# EasyEDA Pro project cubicat_pcb.eprj, schematic Schematic
Create Date: 2024-10-24; Page Name: P1; Project Name: cubicat_CS3; Schematic Name: Schematic1_1; Update Date: 2024-10-24; Company: 嘉立创EDA; Page Size: A4; Version: V1.0
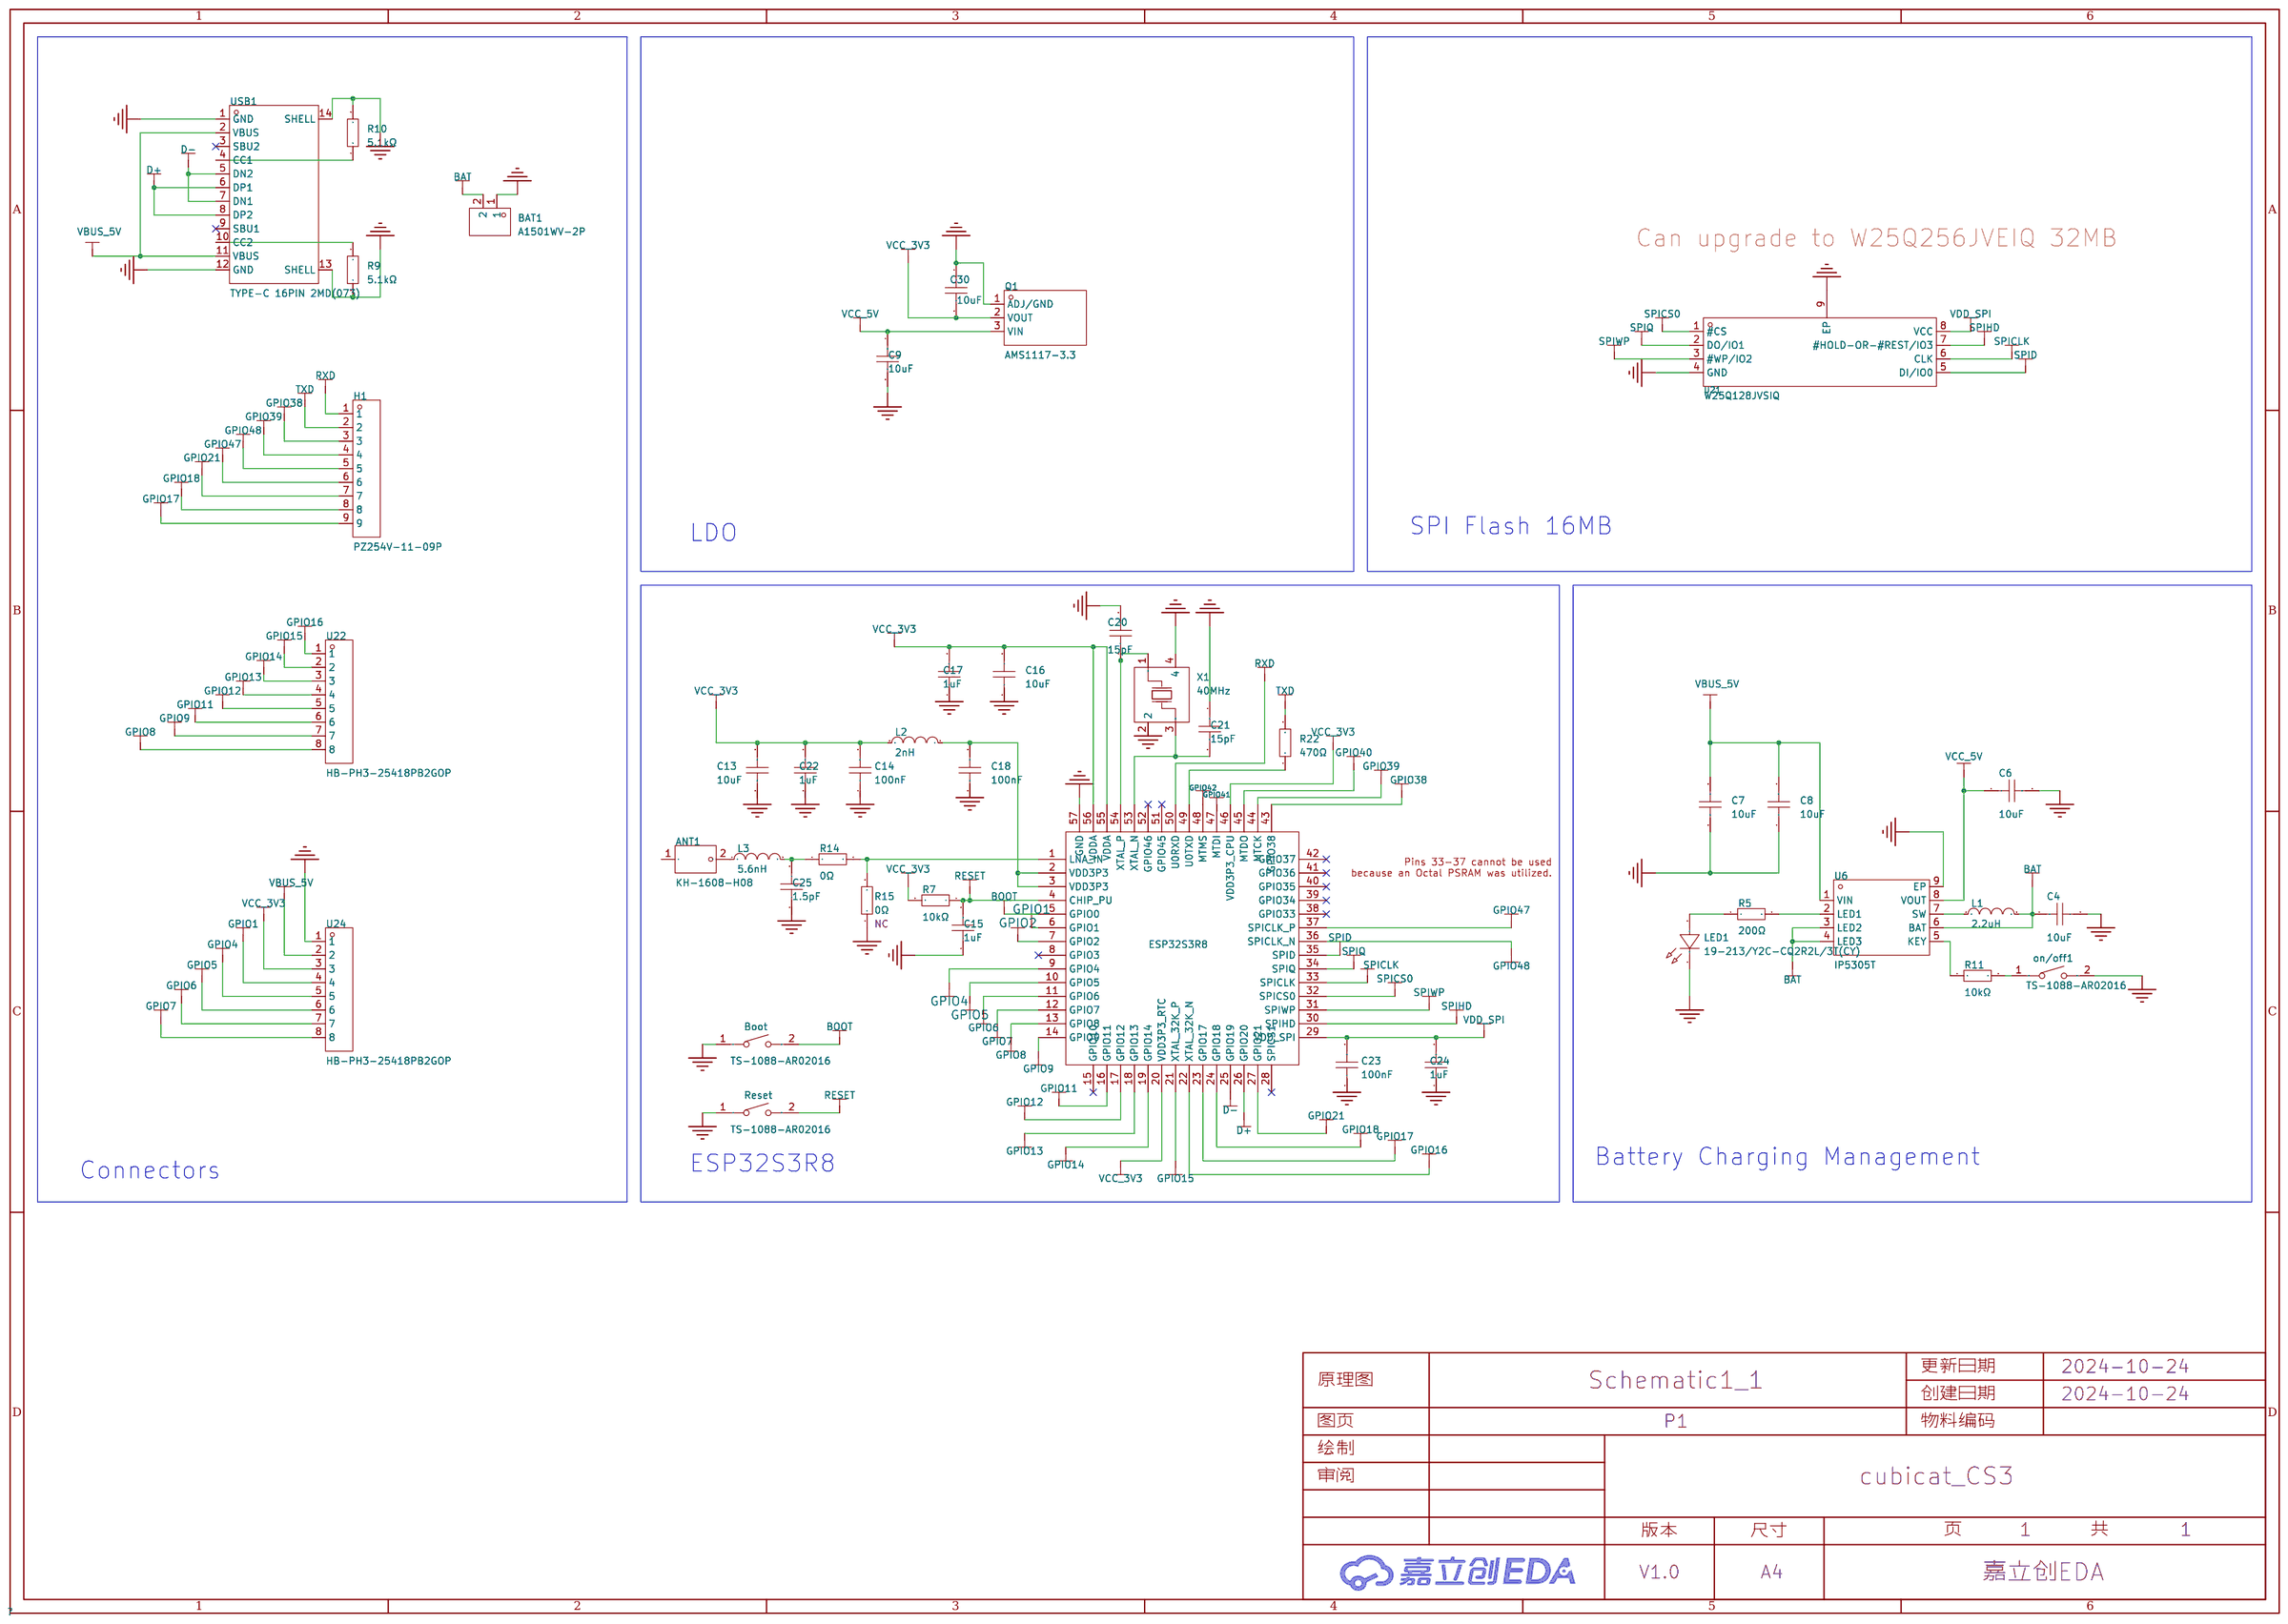
[diagram p0: schematic sheet]

## Parts
ANT1  KH-1608-H08  [ANT-SMD_L1.7-W0.9]
BAT1  A1501WV-2P  [CONN-TH_A1501WV-2P]  (no BOM)
Boot  TS-1088-AR02016  [SW-SMD_L3.9-W3.0-P4.45]
C4  10uF  [C0402]
C6  10uF  [C0402]
C7  10uF  [C0603]
C8  10uF  [C0603]
C9  10uF  [C0402]
C13  10uF  [C0402]
C14  100nF  [C0402]
C15  1uF  [C0402]
C16  10uF  [C0402]
C17  1uF  [C0402]
C18  100nF  [C0402]
C20  15pF  [C0402]
C21  15pF  [C0402]
C22  1uF  [C0402]
C23  100nF  [C0402]
C24  1uF  [C0402]
C25  1.5pF  [C0402]
C30  10uF  [C0402]
ESP32S3R8  -  [esp32s3R8]
H1  PZ254V-11-09P  [HDR-TH_9P-P2.54-V-M]
L1  2.2uH  [IND-SMD_L2.5-W2.0_MHCHL2520]
L2  2nH  [L0402]
L3  5.6nH  [L0402]
LED1  19-213/Y2C-CQ2R2L/3T(CY)  [LED0603-RD-YELLOW]
on/off1  TS-1088-AR02016  [SW-SMD_L3.9-W3.0-P4.45]
Q1  AMS1117-3.3  [SOT-89_L4.5-W2.5-P1.50-LS4.2-BR]
R5  200Ω  [R0402]
R7  10kΩ  [R0402]
R9  5.1kΩ  [R0402]
R10  5.1kΩ  [R0402]
R11  10kΩ  [R0402]
R14  0Ω  [R0402]
R15  0Ω  [R0402]  (no BOM)
R22  470Ω  [R0402]
Reset  TS-1088-AR02016  [SW-SMD_L3.9-W3.0-P4.45]
U6  IP5305T  [ESOP-8_L4.9-W3.9-P1.27-LS6.0-BL-EP]
U21  W25Q128JVSIQ  [SOIC-8_L5.3-W5.3-P1.27-LS8.0-BL]
U22  HB-PH3-25418PB2GOP  [HDR-TH_8P-P2.54-V-M]
U24  HB-PH3-25418PB2GOP  [HDR-TH_8P-P2.54-V-M]
USB1  TYPE-C 16PIN 2MD(073)  [USB-C-SMD_TYPE-C-6PIN-2MD-073]
X1  40MHz  [CRYSTAL-SMD_4P-L2.5-W2.0-BL]

## Library data of the parts
ANT1 = KH-1608-H08: Supplier Part: C2925416; Manufacturer: kinghelm(金航标); Supplier Footprint: 0603; JLCPCB Part Class: 扩展库; Datasheet: https://atta.szlcsc.com/upload/public/pdf/source/20211126/3EE7BF0E326A51E5D543950E9041E299.pdf; Supplier: LCSC
BAT1 = A1501WV-2P: 插针结构:1x2P;间距:1.5mm;安装方式:-;参考系列:ZH;总PIN数:2P;排数:1;每排PIN数:2;行距:-;触头材质:黄铜;; LCSC Part Name: 系列:ZH 间距:1.5mm 1x2P; Supplier Part: C225132; Manufacturer: CJT(长江连接器); Supplier Footprint: 插件,P=1.5mm; JLCPCB Part Class: 扩展库; Datasheet: https://atta.szlcsc.com/upload/public/pdf/source/20180928/C273012_BDE11A7ED864817C692E5CB548553229.pdf; Supplier: LCSC; Pins Structure: 1x2P; Pitch: 1.5mm; Reference Series: ZH; Number of Pins: 2P; Number of Rows: 1; Number of PINs Per Row: 2; Contact Material: 黄铜
Boot on/off1 Reset = TS-1088-AR02016: 电路结构:单刀单掷;按钮形状:圆形按钮;作用力:160gf;安装方式:立贴;开关长度:4mm;开关宽度:3mm;开关高度:2mm;带支架:不带;触点电流:50mA;额定电压(DC):12V;绝缘电阻:100MΩ;机械寿命:10万次;; LCSC Part Name: 4*3*2mm 立贴 轻触开关; Supplier Part: C720477; Manufacturer: XUNPU(讯普); Supplier Footprint: SMD; JLCPCB Part Class: 扩展库; Datasheet: https://atta.szlcsc.com/upload/public/pdf/source/20200810/C720475_60D09DD6C54279ADDB2DC25100F1CC11.pdf; Supplier: LCSC; Circuit: 单刀单掷; Actuator Style: 圆形按钮; Operating Force: 160gf; Mounting Style: 立贴; Switch Length: 4mm; Switch Width: 3mm; Switch Height: 2mm; Strike Gundam: 不带; Contact Current: 50mA; Voltage Rating (DC): 12V; Insulation Resistance: 100MΩ; Actuator/Cap Color: 黑色; Pin Style: SMD接片; Mechanical Life: 10万次; Operating Temperature: -30℃~+80℃
C4 C6 C9 C13 C16 C30 = CL05A106MQ5NUNC: 容值:10uF;精度:±20%;额定电压:6.3V;材质(温度系数):X5R;; LCSC Part Name: 10uF ±20% 6.3V; Supplier Part: C15525; Manufacturer: SAMSUNG(三星); Supplier Footprint: 0402; JLCPCB Part Class: Basic Part; Datasheet: https://atta.szlcsc.com/upload/public/pdf/source/20220823/2B02EE04F8F211D38A52DCB16EB6BEBA.pdf; Supplier: LCSC; Tolerance: ±20%; Voltage Rated: 6.3V; Temperature Coefficient: X5R
C7 C8 = CL10A106KP8NNNC: 容值:10uF;精度:±10%;额定电压:10V;材质(温度系数):X5R;; LCSC Part Name: 10uF ±10% 10V; Supplier Part: C19702; Manufacturer: SAMSUNG(三星); Supplier Footprint: 0603; JLCPCB Part Class: Basic Part; Datasheet: https://atta.szlcsc.com/upload/public/pdf/source/20160218/1457707763339.pdf; Supplier: LCSC; Tolerance: ±10%; Voltage Rated: 10V; Temperature Coefficient: X5R
C14 C18 C23 = CL05B104KO5NNNC: 容值:100nF;精度:±10%;额定电压:16V;材质(温度系数):X7R;; LCSC Part Name: 100nF ±10% 16V; Supplier Part: C1525; Manufacturer: SAMSUNG(三星); Supplier Footprint: 0402; JLCPCB Part Class: Basic Part; Datasheet: https://atta.szlcsc.com/upload/public/pdf/source/20160218/1457707763339.pdf; Supplier: LCSC; Tolerance: ±10%; Voltage Rated: 16V; Temperature Coefficient: X7R
C15 C17 C22 C24 = CL05A105KA5NQNC: 容值:1uF;精度:±10%;额定电压:25V;材质(温度系数):X5R;; LCSC Part Name: 1uF ±10% 25V; Supplier Part: C52923; Manufacturer: SAMSUNG(三星); Supplier Footprint: 0402; JLCPCB Part Class: Basic Part; Datasheet: https://atta.szlcsc.com/upload/public/pdf/source/20160218/1457707763339.pdf; Supplier: LCSC; Tolerance: ±10%; Voltage Rated: 25V; Temperature Coefficient: X5R
C20 C21 = 0402CG150J500NT: 容值:15pF;精度:±5%;额定电压:50V;材质(温度系数):C0G;; LCSC Part Name: 15pF ±5% 50V; Supplier Part: C1548; Manufacturer: FH(风华); Supplier Footprint: 0402; JLCPCB Part Class: Basic Part; Datasheet: https://atta.szlcsc.com/upload/public/pdf/source/20200305/C486355_26A10D38EF8C2A5C37091D0039909270.pdf; Supplier: LCSC; Tolerance: ±5%; Voltage Rated: 50V; Temperature Coefficient: C0G
C25 = CC0402BRNPO9BN1R5: 容值:1.5pF;额定电压:50V;材质(温度系数):NP0;; LCSC Part Name: 1.5pF 50V; Supplier Part: C282238; Manufacturer: YAGEO(国巨); Supplier Footprint: 0402; JLCPCB Part Class: Extended Part; Datasheet: https://atta.szlcsc.com/upload/public/pdf/source/20181008/C309499_21CC21451B82C39E3D92150FD6B30293.pdf; Supplier: LCSC; Voltage Rated: 50V; Temperature Coefficient: NP0
ESP32S3R8 = esp32s3R8
H1 = PZ254V-11-09P: 插针结构:1x9P;间距:2.54mm;行距:-;圆针/方针:方针;安装类型:直插;排数:单排;总PIN位数:9P;额定电流:-;额定电压:-;配合针长度:6mm;塑高:2.5mm;端接针长度:3mm;触头材质:黄铜;触头镀层:-;工作温度范围:-40℃~+105℃;颜色:黑色;; LCSC Part Name: 间距:2.54mm 1x9P 直插 方针; Supplier Part: C492408; Manufacturer: XFCN(兴飞); Supplier Footprint: 插件,P=2.54mm; JLCPCB Part Class: 扩展库; Datasheet: https://atta.szlcsc.com/upload/public/pdf/source/20200309/C492408_0CE6AEE885DD471CEFA4BE32B6482CF7.pdf; Supplier: LCSC; Pin Structure: 1x9P; Pitch: 2.54mm; Circluar Pins/Square Pins: 方针; Mounting Type: 直插; Number of Rows: 单排; Number of Pins: 9P; Length of Mating Pin: 6mm; Insulation Height: 2.5mm; Length of End Connection Pin: 3mm; Contact Material: 黄铜; Operating Temperature Range: -40℃~+105℃; Color: 黑色
L1 = FTC252012S2R2MBCA: 电感值:2.2uH;精度:±20%;额定电流:3A;饱和电流(Isat):3.8A;类型:一体成型电感;; LCSC Part Name: 2.2uH ±20% 3.8A; Supplier Part: C5832372; Manufacturer: cjiang(长江微电); Supplier Footprint: 1008; JLCPCB Part Class: Extended Part; Datasheet: https://atta.szlcsc.com/upload/public/pdf/source/20230602/8FFEDA9C0247A92A0D4B67554BFE4091.pdf; Supplier: LCSC; Tolerance: ±20%; Rated Current: 3A; Saturation Current (Isat): 3.8A; DC Resistance (DCR): 55mΩ; Type: 一体成型电感
L2 = MLG1005S2N0BT000: 电感值:2nH;精度:-;额定电流:900mA;饱和电流(Isat):-;直流电阻(DCR):70mΩ;; Supplier Part: C76769; Manufacturer: TDK; Supplier Footprint: 0402; JLCPCB Part Class: 扩展库; Datasheet: https://atta.szlcsc.com/upload/public/pdf/source/20190403/C275259_14D38AC9DF218780897673DFAA345BA3.pdf; Supplier: LCSC; Rated Current: 900mA; DC Resistance (DCR): 70mΩ; Q @ Freq: 7@100MHz; Frequency - Self Resonant: 7.5GHz
L3 = LQG15HS5N6S02D: 电感值:5.6nH;精度:-;额定电流:650mA;饱和电流(Isat):-;直流电阻(DCR):180mΩ;; Supplier Part: C85670; Manufacturer: muRata(村田); Supplier Footprint: 0402; JLCPCB Part Class: Extended Part; Datasheet: https://atta.szlcsc.com/upload/public/pdf/source/20180612/C185484_14F678484DDF036353DC67B6265A9221.pdf; Supplier: LCSC; Rated Current: 650mA; DC Resistance (DCR): 180mΩ; Q @ Freq: 8@100MHz; Frequency - Self Resonant: 4.5GHz; Type: 厚膜电感
LED1 = 19-213/Y2C-CQ2R2L/3T(CY): 发光颜色:黄色;功率:60mW;正向电流:20mA;主波长:585.5nm~591.5nm;二极管配置:-;透镜颜色:无色透明透镜;色温:-;发光角度:120°;载带方式:-;工作温度:-40℃~+85℃;; LCSC Part Name: 黄灯; Supplier Part: C72038; Manufacturer: EVERLIGHT(亿光); Supplier Footprint: 0603; JLCPCB Part Class: Basic Part; Datasheet: https://atta.szlcsc.com/upload/public/pdf/source/20160507/1462613613586.pdf; Supplier: LCSC; Emitted Color: 黄色; Power Dissipation: 60mW; Forward Current: 20mA; Dominant Wavelength: 585.5nm~591.5nm; Peak Wavelength: 591nm; Lens Color: 无色透明透镜; Viewing Angle: 120°; Operating Temperature: -40℃~+85℃
Q1 = AMS1117-3.3_C347256: 输出类型:固定;最大输入电压:12V;输出电压:3.3V;最大输出电流:1A;电源纹波抑制比(PSRR):60dB@(120Hz);输出极性:正极;; LCSC Part Name: 输出:3.3V 电流:1A 耐压:12V; Supplier Part: C347256; Manufacturer: UMW(友台半导体); Supplier Footprint: SOT-89; JLCPCB Part Class: Extended Part; Datasheet: https://atta.szlcsc.com/upload/public/pdf/source/20231109/155D79A26D9DB04352555A58D5969DC8.pdf; Supplier: LCSC; Output Type: 固定; Maximum Input Voltage: 12V; Output Voltage: 3.3V; MAX Output Current: 1A; Power Supply Rejection Ratio (PSRR): 60dB@(120Hz); Dropout Voltage: 1.3V@(1A); Output Polarity: 正极; Number of Outputs: 1
R5 = 0402WGF2000TCE: 电阻类型:厚膜电阻;阻值:200Ω;精度:±1%;功率:62.5mW;最大工作电压:50V;温度系数:±100ppm/℃;; LCSC Part Name: 200Ω ±1% 62.5mW 厚膜电阻; Supplier Part: C25087; Manufacturer: UNI-ROYAL(厚声); Supplier Footprint: 0402; JLCPCB Part Class: Basic Part; Datasheet: https://atta.szlcsc.com/upload/public/pdf/source/20200306/C422600_1E6D84923E4A46A82E41ADD87F860B5C.pdf; Supplier: LCSC; Type: 厚膜电阻; Tolerance: ±1%; Power(Watts): 62.5mW; Overload Voltage (Max): 50V; Temperature Coefficient: ±100ppm/℃; Operating Temperature Range: -55℃~+155℃
R7 R11 = 0402WGF1002TCE: 电阻类型:厚膜电阻;阻值:10kΩ;精度:±1%;功率:62.5mW;最大工作电压:50V;温度系数:±100ppm/℃;; LCSC Part Name: 10kΩ ±1% 62.5mW 厚膜电阻; Supplier Part: C25744; Manufacturer: UNI-ROYAL(厚声); Supplier Footprint: 0402; JLCPCB Part Class: Basic Part; Datasheet: https://atta.szlcsc.com/upload/public/pdf/source/20200306/C422600_1E6D84923E4A46A82E41ADD87F860B5C.pdf; Supplier: LCSC; Type: 厚膜电阻; Tolerance: ±1%; Power(Watts): 62.5mW; Overload Voltage (Max): 50V; Temperature Coefficient: ±100ppm/℃; Operating Temperature Range: -55℃~+155℃
R9 R10 = 0402WGF5101TCE: 电阻类型:厚膜电阻;阻值:5.1kΩ;精度:±1%;功率:62.5mW;最大工作电压:50V;温度系数:±100ppm/℃;; LCSC Part Name: 5.1kΩ ±1% 62.5mW 厚膜电阻; Supplier Part: C25905; Manufacturer: UNI-ROYAL(厚声); Supplier Footprint: 0402; JLCPCB Part Class: Basic Part; Datasheet: https://atta.szlcsc.com/upload/public/pdf/source/20200306/C422600_1E6D84923E4A46A82E41ADD87F860B5C.pdf; Supplier: LCSC; Type: 厚膜电阻; Tolerance: ±1%; Power(Watts): 62.5mW; Overload Voltage (Max): 50V; Temperature Coefficient: ±100ppm/℃; Operating Temperature Range: -55℃~+155℃
R14 = 0402WGF0000TCE: 电阻类型:厚膜电阻;阻值:0Ω;精度:±1%;功率:62.5mW;最大工作电压:50V;温度系数:±800ppm/℃;; LCSC Part Name: 0Ω ±1% 62.5mW 厚膜电阻; Supplier Part: C17168; Manufacturer: UNI-ROYAL(厚声); Supplier Footprint: 0402; JLCPCB Part Class: Basic Part; Datasheet: https://atta.szlcsc.com/upload/public/pdf/source/20200306/C422600_1E6D84923E4A46A82E41ADD87F860B5C.pdf; Supplier: LCSC; Type: 厚膜电阻; Tolerance: ±1%; Power(Watts): 62.5mW; Overload Voltage (Max): 50V; Temperature Coefficient: ±800ppm/℃; Operating Temperature Range: -55℃~+155℃
R15 = 0402WGF0000TCE: 电阻类型:厚膜电阻;阻值:0Ω;精度:±1%;功率:62.5mW;最大工作电压:50V;温度系数:±800ppm/℃;; LCSC Part Name: 0Ω ±1% 62.5mW 厚膜电阻; Supplier Part: C25087; Manufacturer: UNI-ROYAL(厚声); Supplier Footprint: 0402; JLCPCB Part Class: 基础库; Datasheet: https://atta.szlcsc.com/upload/public/pdf/source/20200306/C422600_1E6D84923E4A46A82E41ADD87F860B5C.pdf; Supplier: LCSC; Type: 厚膜电阻; Tolerance: ±1%; Power(Watts): 62.5mW; Overload Voltage (Max): 50V; Temperature Coefficient: ±800ppm/℃; Operating Temperature Range: -55℃~+155℃; Comment: NC
R22 = 0402WGF4700TCE: 电阻类型:厚膜电阻;阻值:470Ω;精度:±1%;功率:62.5mW;最大工作电压:50V;温度系数:±100ppm/℃;; LCSC Part Name: 470Ω ±1% 62.5mW 厚膜电阻; Supplier Part: C25117; Manufacturer: UNI-ROYAL(厚声); Supplier Footprint: 0402; JLCPCB Part Class: 基础库; Datasheet: https://atta.szlcsc.com/upload/public/pdf/source/20200306/C422600_1E6D84923E4A46A82E41ADD87F860B5C.pdf; Supplier: LCSC; Type: 厚膜电阻; Tolerance: ±1%; Power(Watts): 62.5mW; Overload Voltage (Max): 50V; Temperature Coefficient: ±100ppm/℃; Operating Temperature Range: -55℃~+155℃
U6 = IP5305T: 1.2A 充电 1.0 A 放电高集成度移动电源 SOC; LCSC Part Name: 1.2A 充电 1.0 A 放电高集成度移动电源 SOC; Supplier Part: C2982924; Manufacturer: INJOINIC(英集芯); Supplier Footprint: ESOP-8; JLCPCB Part Class: Extended Part; Datasheet: https://atta.szlcsc.com/upload/public/pdf/source/20231101/AF1D6EF2B6F45C3A53EF983F7EFB3B56.pdf; Supplier: LCSC
U21 = W25Q128JVSIQ: 接口类型:-;存储容量:128Mbit;时钟频率(fc):-;; LCSC Part Name: W25Q128JVSIQ 编带; Supplier Part: C97521; Manufacturer: WINBOND(华邦); Supplier Footprint: SOIC-8-208mil; JLCPCB Part Class: Basic Part; Datasheet: https://atta.szlcsc.com/upload/public/pdf/source/20170316/1489627409956.pdf; Supplier: LCSC; Memory Size: 128Mbit
U22 U24 = HB-PH3-25418PB2GOP: 插针结构:1x8P;间距:2.54mm;行距:2.54mm;圆针/方针:方针;安装类型:直插;排数:单排;总PIN位数:8P;额定电流:3A;额定电压:250V;配合针长度:6mm;塑高:2.54mm;端接针长度:3mm;触头材质:黄铜;触头镀层:金;工作温度范围:-40℃~+105℃;焊接温度(最大值):260℃;颜色:黑色;; LCSC Part Name: 间距:2.54mm 1x8P 直插 方针; Supplier Part: C6332201; Manufacturer: HANBO(汉博); Supplier Footprint: 插件,P=2.54mm; JLCPCB Part Class: 扩展库; Datasheet: https://atta.szlcsc.com/upload/public/pdf/source/20230803/F72D259687963761DF1B552F3BB84A31.pdf; Supplier: LCSC; Pin Structure: 1x8P; Pitch: 2.54mm; Row Spacing: 2.54mm; Circluar Pins/Square Pins: 方针; Mounting Type: 直插; Number of Rows: 单排; Number of Pins: 8P; Current Rating (Max): 3A; Voltage Rating (Max): 250V; Length of Mating Pin: 6mm; Insulation Height: 2.54mm; Length of End Connection Pin: 3mm; Contact Material: 黄铜; Contact Plating: 金; Operating Temperature Range: -40℃~+105℃; Soldering Temperature(Max): 260℃; Color: 黑色
USB1 = TYPE-C 16PIN 2MD(073): 连接器类型:Type-C;标准:-;公母:母;端口数量:1;触点数量:16P;安装方式:卧贴;额定电流 - 电源:5A;工作温度范围:-25℃~+85℃;; LCSC Part Name: Type-C 母 卧贴; Supplier Part: C2765186; Manufacturer: SHOU HAN(首韩); Supplier Footprint: SMD; JLCPCB Part Class: 扩展库; Datasheet: https://atta.szlcsc.com/upload/public/pdf/source/20211123/39B17C16241EAC15C5E277BDA434118E.pdf; Supplier: LCSC; Connector Type: Type-C; Gender: 母; Number of Ports: 1; Number of Contacts: 16P; Mounting Style: 卧贴; Current Rating - Power (Max): 5A; Operating Temperature Range: -25℃~+85℃
X1 = TXM40M0004252HBCEO00T: 晶振类型:贴片晶振;频率:40MHz;常温频差:±10ppm;外接负载电容:15pF;频率稳定度(全温):±30ppm;; LCSC Part Name: 40MHz ±10ppm 15pF; Supplier Part: C284176; Manufacturer: YJX(雅晶鑫); Supplier Footprint: SMD2520-4P; JLCPCB Part Class: 扩展库; Datasheet: https://atta.szlcsc.com/upload/public/pdf/source/20180910/C284176_7C227CDEF2A90AF7BF47AD2F9582364C.pdf; Supplier: LCSC; Crystal Type: 贴片晶振; Normal temperature Frequency Tolerance: ±10ppm; External load capacitor: 15pF; Frequency Stability(Full temperature range): ±30ppm; Equivalent Series Resistance (ESR): 25Ω; Operating Temperature: -40℃~+85℃

## Nets
GND: BAT1.1 Boot.1 C4.2 C6.2 C7.1 C8.1 C9.2 C13.1 C14.1 C15.1 C16.1 C17.1 C18.1 C20.2 C21.1 C22.1 C23.1 C24.1 C25.1 C30.1 ESP32S3R8.57(GND) LED1.1(K) on/off1.2 Q1.1(ADJ/GND) R9.1 R10.2 R15.1 Reset.1 U6.9(EP) U21.4(GND) U21.9(EP) U24.1 USB1.1(GND) USB1.12(GND) USB1.13(SHELL) USB1.14(SHELL) X1.2 X1.4
VBUS_5V: C7.2 C8.2 U6.1(VIN) U24.2 USB1.2(VBUS) USB1.11(VBUS)
VCC_3V3: C13.2 C14.2 C16.2 C17.2 C22.2 C30.2 ESP32S3R8.20(VDD3P3_RTC) ESP32S3R8.46(VDD3P3_CPU) ESP32S3R8.55(VDDA) ESP32S3R8.56(VDDA) L2.1 Q1.2(VOUT) R7.2 U24.3
VCC_5V: C6.1 C9.1 Q1.3(VIN) U6.8(VOUT)
VDD_SPI: C23.2 C24.2 ESP32S3R8.29(VDD_SPI) U21.8(VCC)
BAT: BAT1.2 C4.1 L1.2 U6.3(LED2) U6.4(LED3) U6.6(BAT)
BOOT: Boot.2 ESP32S3R8.5(GPIO0)
D+: ESP32S3R8.26(GPIO20) USB1.6(DP1) USB1.8(DP2)
D-: ESP32S3R8.25(GPIO19) USB1.5(DN2) USB1.7(DN1)
GPIO1: ESP32S3R8.6(GPIO1) U24.4
GPIO2: ESP32S3R8.7(GPIO2)
GPIO4: ESP32S3R8.9(GPIO4) U24.5
GPIO5: ESP32S3R8.10(GPIO5) U24.6
GPIO6: ESP32S3R8.11(GPIO6) U24.7
GPIO7: ESP32S3R8.12(GPIO7) U24.8
GPIO8: ESP32S3R8.13(GPIO8) U22.8
GPIO9: ESP32S3R8.14(GPIO9) U22.7
GPIO11: ESP32S3R8.16(GPIO11) U22.6
GPIO12: ESP32S3R8.17(GPIO12) U22.5
GPIO13: ESP32S3R8.18(GPIO13) U22.4
GPIO14: ESP32S3R8.19(GPIO14) U22.3
GPIO15: ESP32S3R8.21(XTAL_32K_P) U22.2
GPIO16: ESP32S3R8.22(XTAL_32K_N) U22.1
GPIO17: ESP32S3R8.23(GPIO17) H1.9
GPIO18: ESP32S3R8.24(GPIO18) H1.8
GPIO21: ESP32S3R8.27(GPIO21) H1.7
GPIO38: ESP32S3R8.43(GPIO38) H1.3
GPIO39: ESP32S3R8.44(MTCK) H1.4
GPIO40: ESP32S3R8.45(MTDO)
GPIO41: ESP32S3R8.47(MTDI)
GPIO42: ESP32S3R8.48(MTMS)
GPIO47: ESP32S3R8.37(SPICLK_P) H1.6
GPIO48: ESP32S3R8.36(SPICLK_N) H1.5
RESET: C15.2 ESP32S3R8.4(CHIP_PU) R7.1 Reset.2
RXD: ESP32S3R8.50(U0RXD) H1.1
SPICLK: ESP32S3R8.33(SPICLK) U21.6(CLK)
SPICS0: ESP32S3R8.32(SPICS0) U21.1(#CS)
SPID: ESP32S3R8.35(SPID) U21.5(DI/IO0)
SPIHD: ESP32S3R8.30(SPIHD) U21.7(#HOLD-OR-#REST/IO3)
SPIQ: ESP32S3R8.34(SPIQ) U21.2(DO/IO1)
SPIWP: ESP32S3R8.31(SPIWP) U21.3(#WP/IO2)
TXD: H1.2 R22.2
$1N4062: L1.1 U6.7(SW)
$1N4068: LED1.2(A) R5.1
$1N4069: R5.2 U6.2(LED1)
$1N4090: R10.1 USB1.4(CC1)
$1N4091: R9.2 USB1.10(CC2)
$1N4092: on/off1.1 R11.2
$1N4094: R11.1 U6.5(KEY)
$1N4114: C21.2 ESP32S3R8.53(XTAL_N) X1.3(OSC2)
$1N4115: C20.1 ESP32S3R8.54(XTAL_P) X1.1(OSC1)
$1N4126: C18.2 ESP32S3R8.2(VDD3P3) ESP32S3R8.3(VDD3P3) L2.2
$1N4130: ANT1.2 L3.1
$1N4132: C25.2 L3.2 R14.1
$1N4134: ESP32S3R8.1(LNA_IN) R14.2 R15.2
$1N4203: ESP32S3R8.49(U0TXD) R22.1

Not connected (* = marked no-connect by the designer): ANT1 1; ESP32S3R8 8(GPIO3)* 15(GPIO10)* 28(SPICS1)* 38(GPIO33)* 39(GPIO34)* 40(GPIO35)* 41(GPIO36)* 42(GPIO37)* 51(GPIO45)* 52(GPIO46)*; USB1 3(SBU2)* 9(SBU1)*

## Notes on the sheet
- Can upgrade to W25Q256JVEIQ 32MB
- LDO
- SPI Flash 16MB
- Pins 33-37 cannot be used
  because an Octal PSRAM was utilized.
- Connectors
- ESP32S3R8
- Battery Charging Management
